# EasyEDA Pro project Athena.eprj, schematic Schematic, sheet 1 of 4

## Sheets
1 Processors: Board Name: Board; Create Date: 2025-08-10; Page Name: Processors; Project Name: Athena; Schematic Name: Schematic; Update Date: 2025-09-05; Company: EasyEDA.com; Page Size: A4; Version: V1.0
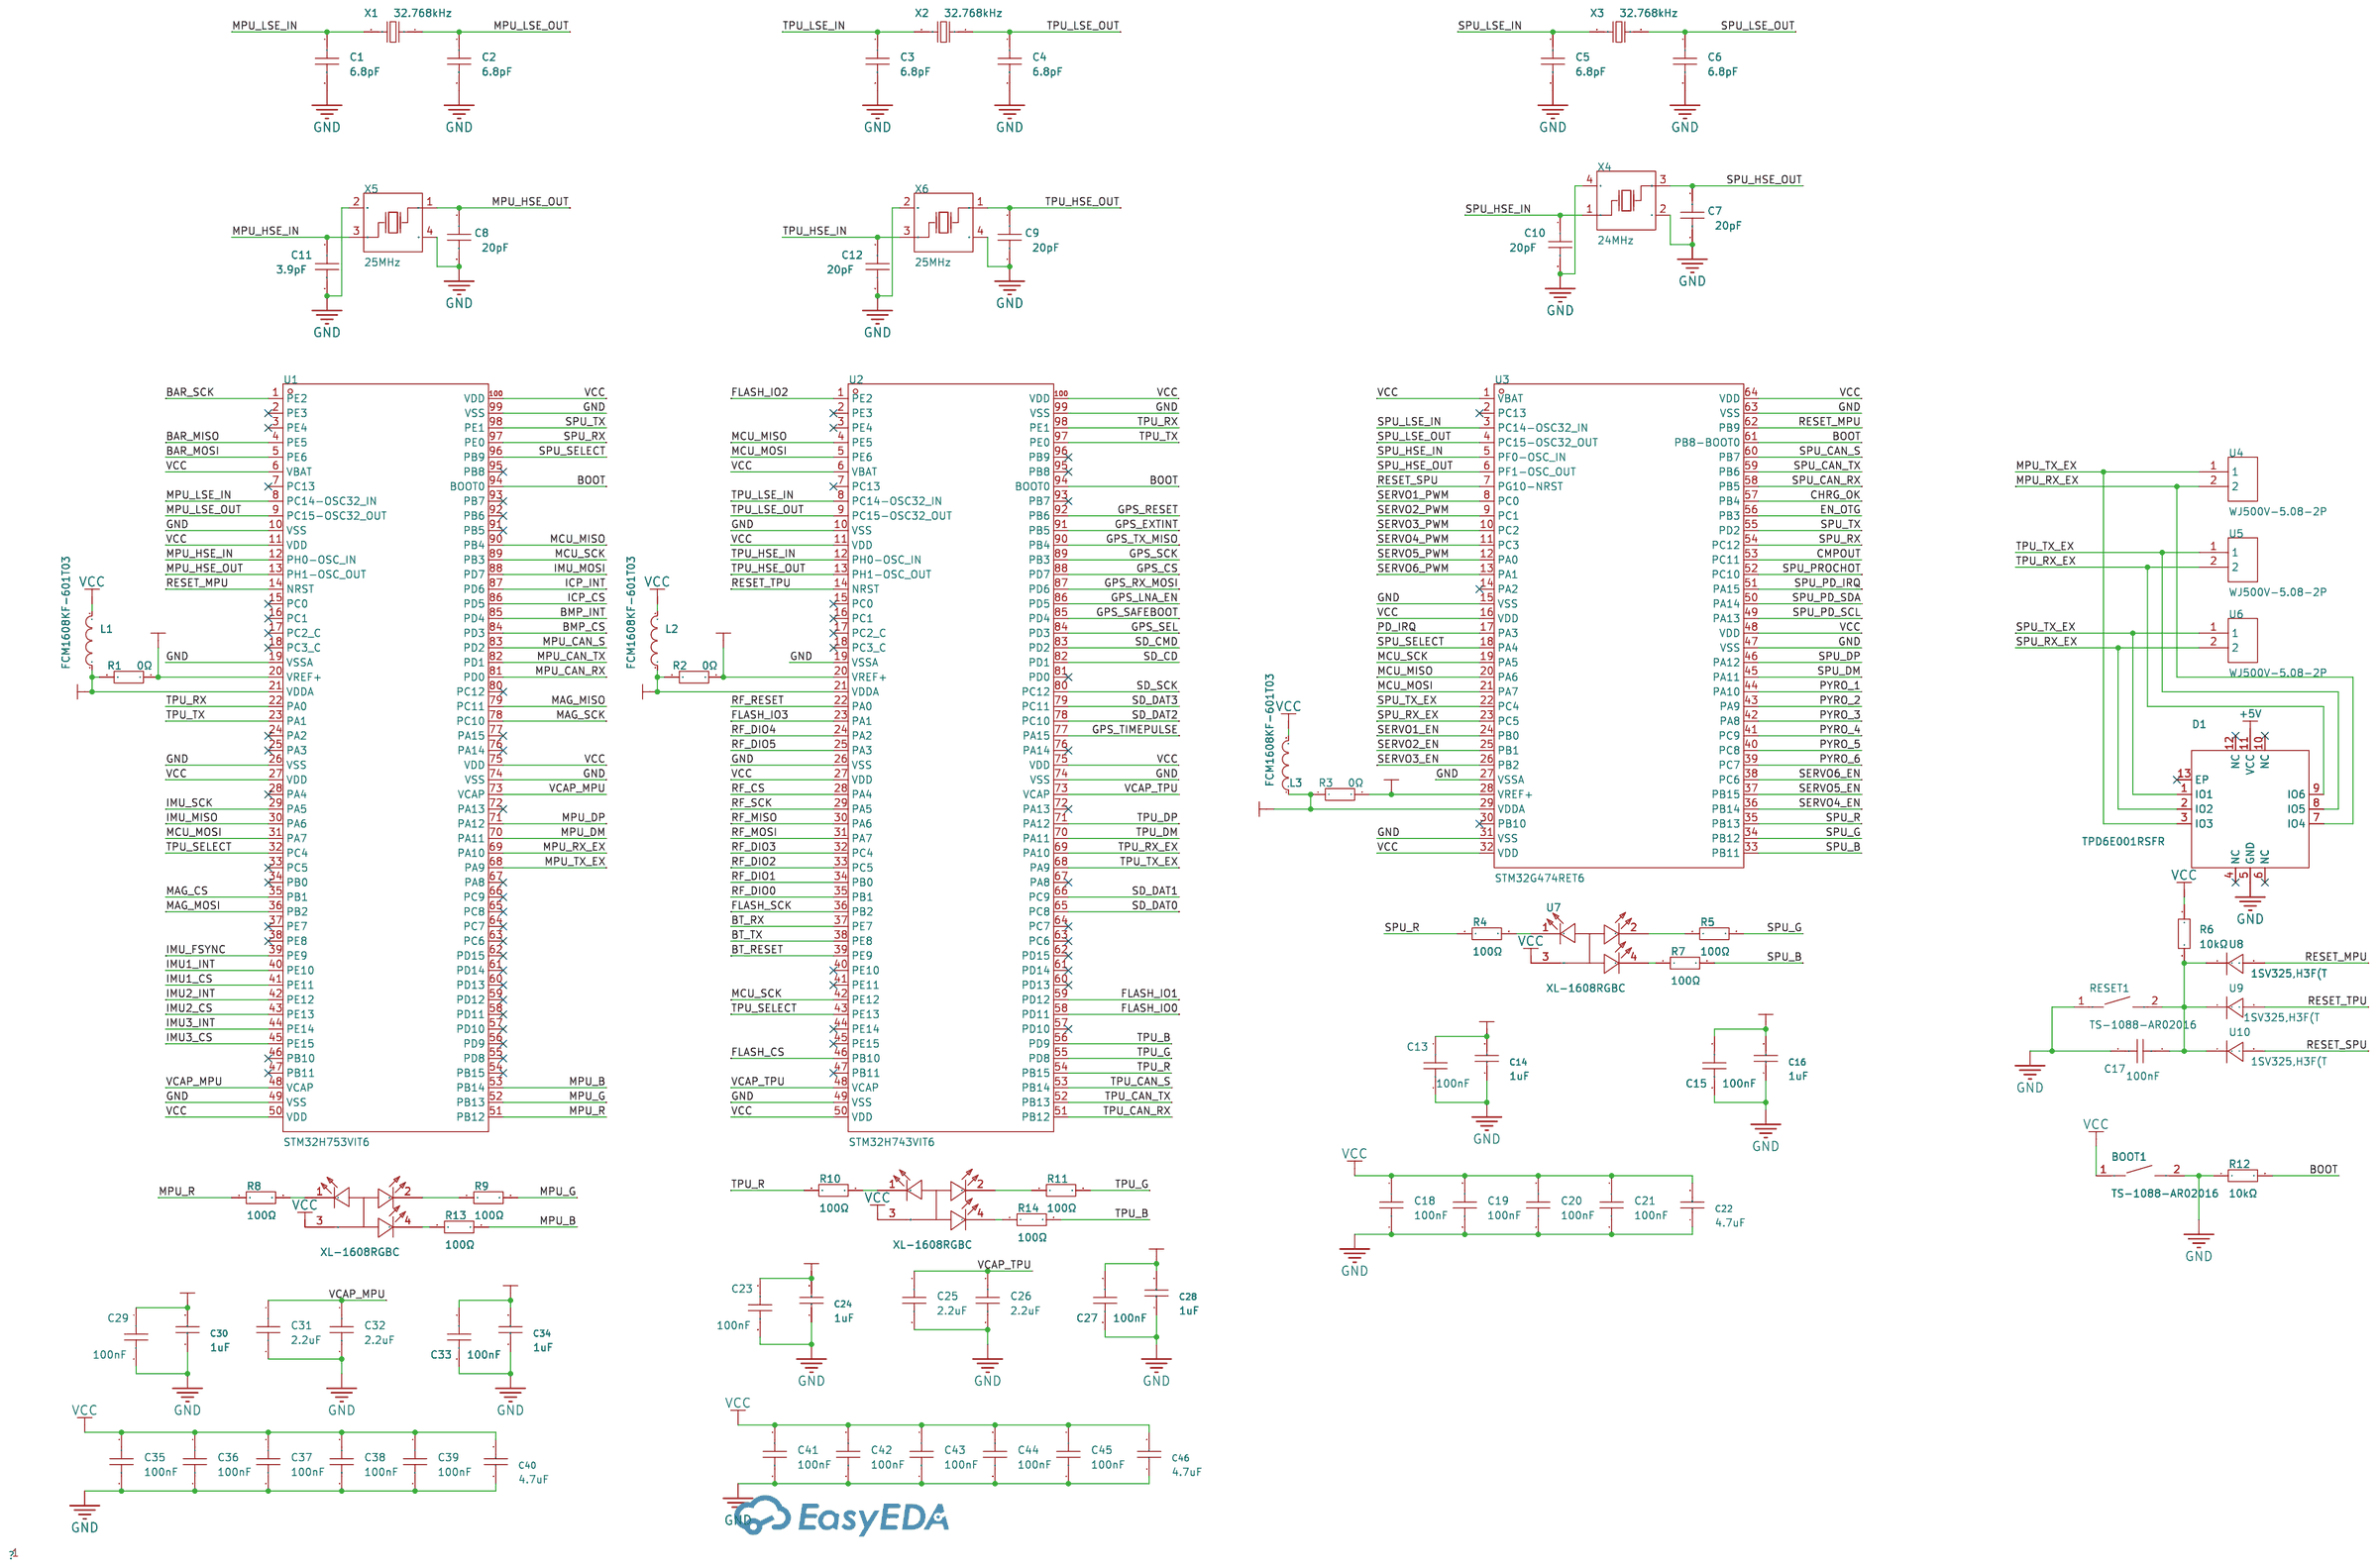
[diagram p0: Processors]

## Parts
BOOT1  6.8pF  [SW-SMD_L3.9-W3.0-P4.45]
C1  6.8pF  [C0402]
C2  6.8pF  [C0402]
C3  6.8pF  [C0402]
C4  6.8pF  [C0402]
C5  6.8pF  [C0402]
C6  6.8pF  [C0402]
C7  20pF  [C0402]
C8  20pF  [C0402]
C9  20pF  [C0402]
C10  20pF  [C0402]
C11  3.9pF  [C0402]
C12  20pF  [C0402]
C13  100nF  [C0402]
C14  1uF  [C0402]
C15  100nF  [C0402]
C16  1uF  [C0402]
C17  100nF  [C0402]
C18  100nF  [C0402]
C19  100nF  [C0402]
C20  100nF  [C0402]
C21  100nF  [C0402]
C22  4.7uF  [C0402]
C23  100nF  [C0402]
C24  1uF  [C0402]
C25  2.2uF  [C0402]
C26  2.2uF  [C0402]
C27  100nF  [C0402]
C28  1uF  [C0402]
C29  100nF  [C0402]
C30  1uF  [C0402]
C31  2.2uF  [C0402]
C32  2.2uF  [C0402]
C33  100nF  [C0402]
C34  1uF  [C0402]
C35  100nF  [C0402]
C36  100nF  [C0402]
C37  100nF  [C0402]
C38  100nF  [C0402]
C39  100nF  [C0402]
C40  4.7uF  [C0402]
C41  100nF  [C0402]
C42  100nF  [C0402]
C43  100nF  [C0402]
C44  100nF  [C0402]
C45  100nF  [C0402]
C46  4.7uF  [C0402]
D1  TPD6E001RSFR  [QFN-12_L4.0-W4.0-P0.80-BL-EP1.7]
L1  FCM1608KF-601T03  [L0603]
L2  FCM1608KF-601T03  [L0603]
L3  FCM1608KF-601T03  [L0603]
R1  0Ω  [R0402]
R2  0Ω  [R0402]
R3  0Ω  [R0402]
R4  100Ω  [R0402]
R5  100Ω  [R0402]
R6  10kΩ  [R0603]
R7  100Ω  [R0402]
R8  100Ω  [R0402]
R9  100Ω  [R0402]
R10  100Ω  [R0402]
R11  100Ω  [R0402]
R12  10kΩ  [R0402]
R13  100Ω  [R0402]
R14  100Ω  [R0402]
RESET1  TS-1088-AR02016  [SW-SMD_L3.9-W3.0-P4.45]
U1  STM32H753VIT6  [LQFP-100_L14.0-W14.0-P0.50-LS16.0-BL]
U2  STM32H743VIT6  [LQFP-100_L14.0-W14.0-P0.50-LS16.0-BL]
U3  STM32G474RET6  [LQFP-64_L10.0-W10.0-P0.50-LS12.0-BL]
U4  WJ500V-5.08-2P  [CONN-TH_2P-P5.00_WJ500V-5.08-2P]
U5  WJ500V-5.08-2P  [CONN-TH_2P-P5.00_WJ500V-5.08-2P]
U6  WJ500V-5.08-2P  [CONN-TH_2P-P5.00_WJ500V-5.08-2P]
U7  XL-1608RGBC  [LED-SMD_4P-L1.6-W0.8-BL]
U8  1SV325,H3F(T  [SOD-523_L1.2-W0.8-LS1.6-RD]
U9  1SV325,H3F(T  [SOD-523_L1.2-W0.8-LS1.6-RD]
U10  1SV325,H3F(T  [SOD-523_L1.2-W0.8-LS1.6-RD]
U11  XL-1608RGBC  [LED-SMD_4P-L1.6-W0.8-BL]
U12  XL-1608RGBC  [LED-SMD_4P-L1.6-W0.8-BL]
X1  32.768kHz  [FC-135R_L3.2-W1.5]
X2  32.768kHz  [FC-135R_L3.2-W1.5]
X3  32.768kHz  [FC-135R_L3.2-W1.5]
X4  24MHz  [CRYSTAL-SMD_4P-L3.2-W2.5-BL]
X5  25MHz  [CRYSTAL-SMD_4P-L3.2-W2.5-BL]
X6  25MHz  [CRYSTAL-SMD_4P-L3.2-W2.5-BL]

## Library data of the parts
BOOT1 = TS-1088-AR02016: LCSC Part Name: 4*3*2mm 立贴 轻触开关; Supplier Part: C720477; Manufacturer: XUNPU(讯普); Supplier Footprint: SMD; JLCPCB Part Class: Basic Part; Datasheet: https://atta.szlcsc.com/upload/public/pdf/source/20200810/C720475_60D09DD6C54279ADDB2DC25100F1CC11.pdf; Supplier: LCSC; Circuit: SPST; Actuator Style: Round Button; Operating Force: 160gf; Mounting Style: Brick nogging; Switch Length: 4mm; Switch Width: 3mm; Switch Height: 2mm; Strike Gundam: 不带; Contact Current: 50mA; Voltage Rating (DC): 12V; Insulation Resistance: 100MΩ; Actuator/Cap Color: Black; Pin Style: SMDSplicing; Mechanical Life: 10万次; Operating Temperature: -30℃~+80℃; Voltage Rating: 50V
C1-C6 = CC0402CRNPO9BN6R8: LCSC Part Name: ±0.25pF 6.8pF 50V; Supplier Part: C189470; Manufacturer: YAGEO(国巨); Supplier Footprint: 0402; JLCPCB Part Class: Extended Part; Datasheet: https://item.szlcsc.com/datasheet/CC0402CRNPO9BN6R8/200930.html; Supplier: LCSC; Voltage Rating: 50V; Temperature Coefficient: NP0; Standardization Check: false
C7-C10 C12 = CC0402JRNPO9BN200: LCSC Part Name: 20pF ±5% 50V; Supplier Part: C107000; Manufacturer: YAGEO(国巨); Supplier Footprint: 0402; JLCPCB Part Class: Extended Part; Datasheet: https://atta.szlcsc.com/upload/public/pdf/source/20170914/C128857_1505359892143968080.pdf; Supplier: LCSC; Tolerance: ±5%; Standardization Check: true
C11 = 0402CG3R9C500NT: LCSC Part Name: ±0.25pF 3.9pF 50V; Supplier Part: C1566; Manufacturer: FH(风华); Supplier Footprint: 0402; JLCPCB Part Class: Extended Part; Datasheet: https://item.szlcsc.com/datasheet/0402CG3R9C500NT/1918.html; Supplier: LCSC; Voltage Rating: 50V; Temperature Coefficient: C0G; Standardization Check: true
C13 C15 C17-C21 C23 C27 C29 C33 C35-C39 C41-C45 = GRM155R71H104KE14D: LCSC Part Name: 100nF ±10% 50V; Supplier Part: C77020; Manufacturer: muRata(村田); Supplier Footprint: 0402; JLCPCB Part Class: Extended Part; Datasheet: https://atta.szlcsc.com/upload/public/pdf/source/20180326/C77020_39BD49C951FF1AF0DB1F1FAC5AC1E401.pdf; Supplier: LCSC; Tolerance: ±10%; Standardization Check: false
C14 C16 C24 C28 C30 C34 = CL05A105KP5NNNC: LCSC Part Name: 1uF ±10% 10V; Supplier Part: C14445; Manufacturer: SAMSUNG(三星); Supplier Footprint: 0402; JLCPCB Part Class: Extended Part; Datasheet: https://item.szlcsc.com/datasheet/CL05A105KP5NNNC/15107.html; Supplier: LCSC; Tolerance: ±10%; Voltage Rating: 10V; Temperature Coefficient: X5R
C22 C40 C46 = CL05A475MP5NRNC: LCSC Part Name: 4.7uF ±20% 10V; Supplier Part: C23733; Manufacturer: SAMSUNG(三星); Supplier Footprint: 0402; JLCPCB Part Class: Basic Part; Datasheet: https://item.szlcsc.com/datasheet/CL05A475MP5NRNC/24469.html; Supplier: LCSC; Tolerance: ±20%; Voltage Rating: 10V; Temperature Coefficient: X5R
C25 C26 C31 C32 = CL05A225KO5NQNC: LCSC Part Name: 2.2uF ±10% 16V; Supplier Part: C170151; Manufacturer: SAMSUNG(三星); Supplier Footprint: 0402; JLCPCB Part Class: Extended Part; Datasheet: https://item.szlcsc.com/datasheet/CL05A225KO5NQNC/181536.html; Supplier: LCSC; Tolerance: ±10%; Voltage Rating: 16V; Temperature Coefficient: X5R; Standardization Check: false
D1 = TPD6E001RSFR: Supplier Part: C1975428; Manufacturer: TI(德州仪器); Supplier Footprint: QFN-12-EP(4x4); JLCPCB Part Class: Extended Part; Datasheet: https://www.ti.com/cn/lit/gpn/tpd6e001; Supplier: LCSC; Reverse Stand-Off Voltage (Vrwm): 5V; Breakdown Voltage: 11V; Operating Temperature: -40℃~+85℃@(Ta); Type: ESD
L1-L3 = FCM1608KF-601T03: Impedance @ Frequency:600Ω@100MHz Tolerance:±25% Tolerance:±25% DC Resistance:500mΩ Current Rating:350mA Circuits:1; LCSC Part Name: 单路 0603磁珠 阻抗600Ω@100MHz; Supplier Part: C141723; Manufacturer: TAI-TECH(台庆); Supplier Footprint: 0603; JLCPCB Part Class: Extended Part; Datasheet: https://atta.szlcsc.com/upload/public/pdf/source/20200917/C141723_92A33AED1D8E5BDD57999587466F99AE.pdf; Supplier: LCSC; Impedance @ Frequency: 600Ω@100MHz; Tolerance: ±25%; DC Resistance: 500mΩ; Current Rating: 350mA; Circuits: 1
R1-R3 = 0402WGF0000TCE: LCSC Part Name: 0Ω ±1% 62.5mW 厚膜电阻; Supplier Part: C17168; Manufacturer: UNI-ROYAL(厚声); Supplier Footprint: 0402; JLCPCB Part Class: Basic Part; Datasheet: https://item.szlcsc.com/datasheet/0402WGF0000TCE/17853.html; Supplier: LCSC; Type: Thick Film Resistor; Tolerance: ±1%; Power(Watts): 62.5mW; Voltage-Supply(Max): 50V; Temperature Coefficient: ±800ppm/℃; Operating Temperature: -55℃~+155℃; Standardization Check: false
R4 R5 R7-R11 R13 R14 = 0402WGF1000TCE: LCSC Part Name: 100Ω ±1% 62.5mW 厚膜电阻; Supplier Part: C25076; Manufacturer: UNI-ROYAL(厚声); Supplier Footprint: 0402; JLCPCB Part Class: Basic Part; Datasheet: https://atta.szlcsc.com/upload/public/pdf/source/20200306/C422600_1E6D84923E4A46A82E41ADD87F860B5C.pdf; Supplier: LCSC; Type: Thick Film Resistors; Tolerance: ±1%; Temperature Coefficient: ±200ppm/℃; Operating Temperature Range: -55℃~+155℃; Standardization Check: false
R6 = 0603WAF1002T5E: Type:Thick Film Resistor Resistance:10kΩ Tolerance:±1% Tolerance:±1% Power(Watts):100mW Voltage-Supply(Max):75V Temperature Coefficient:±100ppm/℃ Temperature Coefficient:±100ppm/℃ Operating Temperature:-55℃~+155℃ Operating Temperature:-55℃~+155℃; LCSC Part Name: 厚膜电阻 10kΩ ±1% 100mW; Supplier Part: C25804; Manufacturer: UNI-ROYAL(厚声); Supplier Footprint: 0603; JLCPCB Part Class: Basic Part; Datasheet: https://item.szlcsc.com/datasheet/0603WAF1002T5E/26547.html; Supplier: LCSC; Type: Thick Film Resistor; Tolerance: ±1%; Power(Watts): 100mW; Voltage-Supply(Max): 75V; Temperature Coefficient: ±100ppm/℃; Operating Temperature: -55℃~+155℃
R12 = 0402WGF1002TCE: LCSC Part Name: 10kΩ ±1% 62.5mW 厚膜电阻; Supplier Part: C25744; Manufacturer: UNI-ROYAL(厚声); Supplier Footprint: 0402; JLCPCB Part Class: Basic Part; Datasheet: https://item.szlcsc.com/datasheet/0402WGF1002TCE/26487.html; Supplier: LCSC; Type: Thick Film Resistor; Tolerance: ±1%; Power(Watts): 62.5mW; Voltage-Supply(Max): 50V; Temperature Coefficient: ±100ppm/℃; Operating Temperature: -55℃~+155℃; Standardization Check: false
RESET1 = TS-1088-AR02016: LCSC Part Name: 4*3*2mm 立贴 轻触开关; Supplier Part: C720477; Manufacturer: XUNPU(讯普); Supplier Footprint: SMD; JLCPCB Part Class: Basic Part; Datasheet: https://atta.szlcsc.com/upload/public/pdf/source/20200810/C720475_60D09DD6C54279ADDB2DC25100F1CC11.pdf; Supplier: LCSC; Circuit: SPST; Actuator Style: Round Button; Operating Force: 160gf; Mounting Style: Brick nogging; Switch Length: 4mm; Switch Width: 3mm; Switch Height: 2mm; Strike Gundam: 不带; Contact Current: 50mA; Voltage Rating (DC): 12V; Insulation Resistance: 100MΩ; Actuator/Cap Color: Black; Pin Style: SMDSplicing; Mechanical Life: 10万次; Operating Temperature: -30℃~+80℃
U1 = STM32H753VIT6: LCSC Part Name: 带DSP和DP-FPU的高性能ARM Cortex-M7 MCU，具有2 MB Flash、1 MB RAM、480 MHz CPU、ART加速器、一级缓存、外部存储器接口、包括加密加速器在内的大量外设以及安全服务支持; Supplier Part: C730206; Manufacturer: ST(意法半导体); Supplier Footprint: LQFP-100(14x14); JLCPCB Part Class: Extended Part; Datasheet: https://item.szlcsc.com/datasheet/STM32H753VIT6/778161.html; Supplier: LCSC
U2 = STM32H743VIT6_C114409: CPU Core:ARM Cortex-M Series CPU Maximum Speed:480MHz Program Storage Size:2MB Number of I/O:82 ADC (Bit):16bit DAC (Bit):12bit Voltage - Supply:1.71V~3.6V Voltage - Supply:1.71V~3.6V Applications:-; LCSC Part Name: 带DSP和DP-FPU的高性能ARM Cortex-M7 MCU，具有2 MB Flash、1 MB RAM、480 MHz CPU、ART加速器、一级缓存、外部存储器接口和大量外设; Supplier Part: C114409; Manufacturer: ST(意法半导体); Supplier Footprint: LQFP-100(14x14); JLCPCB Part Class: Extended Part; Datasheet: https://atta.szlcsc.com/upload/public/pdf/source/20200508/C529058_DA70143F266D6D825C3A912656F12A87.pdf; Supplier: LCSC; CPU Core: ARM Cortex-M Series; CPU Maximum Speed: 480MHz; Program Storage Size: 2MB; Number of I/O: 82; ADC (Bit): 16bit; DAC (Bit): 12bit; Voltage - Supply: 1.71V~3.6V
U3 = STM32G474RET6: CPU Core:ARM-M4 CPU Maximum Speed:170MHz Program Storage Size:512KB Program Memory Type:FLASH Number of I/O:52 ADC (Bit):12bit DAC (Bit):12bit Voltage - Supply:1.71V~3.6V Voltage - Supply:1.71V~3.6V Applications:-; LCSC Part Name: 带DSP和FPU的170MHz主流ARM Cortex-M4 MCU，具有512 KB Flash存储器、数学加速器、高分辨率定时器和高模拟电平集成; Supplier Part: C521608; Manufacturer: ST(意法半导体); Supplier Footprint: LQFP-64(10x10); JLCPCB Part Class: Extended Part; Datasheet: https://item.szlcsc.com/datasheet/STM32G474RET6/538858.html; Supplier: LCSC; CPU Core: ARM-M4; CPU Maximum Speed: 170MHz; Program Storage Size: 512KB; Program Memory Type: FLASH; Number of I/O: 52; ADC (Bit): 12bit; DAC (Bit): 12bit; Voltage - Supply: 1.71V~3.6V
U4-U6 = WJ500V-5.08-2P: LCSC Part Name: 1x2P 5.08mm 直插 排数:1 每排P数:2; Supplier Part: C8465; Manufacturer: KANGNEX(康奈克斯电气); Supplier Footprint: 插件,P=5.08mm; JLCPCB Part Class: Extended Part; Datasheet: https://atta.szlcsc.com/upload/public/pdf/source/20191225/C8465_02D34CE5B5B4A53DF5891601D97FA9F4.pdf; Supplier: LCSC; Structure: 1x2P; Pitch: 5.08mm; Color: Green; Mounting Style: Direct Insert; Current Rating (Max): 18A; Voltage Rating (Max): 250V; Number of Pins: 2P; Number of Rows: 1; Wire Gauge - AWG: 14~30; Wire Gauge - mm2: 2.5; Number of PINs Per Row: 2; Operating Temperature Range: -40℃~+105℃; Screw Specification: M2.5
U7 U11 U12 = XL-1608RGBC: Supplier Part: C5349936; Manufacturer: XINGLIGHT(成兴光); Supplier Footprint: 0603; JLCPCB Part Class: Extended Part; Datasheet: https://atta.szlcsc.com/upload/public/pdf/source/20240218/D6E53B1911387F9E4C84048A3296A5A3.pdf; Supplier: LCSC; Viewing Angle: 120°; Lens Color: Colorless transparent lens; Installation Method: Positive Stick; Operating Temperature: -30℃~+85℃
U8-U10 = 1SV325,H3F(T: Supplier Part: C4153758; Manufacturer: TOSHIBA(东芝); Supplier Footprint: SOD-523; JLCPCB Part Class: Extended Part; Datasheet: https://atta.szlcsc.com/upload/public/pdf/source/20210326/C2762670_F0C124BCF192D7BD99D0C869063EDCD5.pdf; Supplier: LCSC
X1-X3 = Q13FC13500004_C32346: LCSC Part Name: 32.768kHz ±20ppm 12.5pF; Supplier Part: C32346; Manufacturer: EPSON(爱普生); Manufacturer Part: Q13FC13500004; Supplier Footprint: SMD3215-2P; JLCPCB Part Class: Basic Part; Datasheet: https://atta.szlcsc.com/upload/public/pdf/source/20240418/0E0FF5F0356BA3753F616001439D1416.pdf; Supplier: LCSC; Crystal Type: Surface Mount Crystal; Normal temperature Frequency Tolerance: ±20ppm; Equivalent Series Resistance (ESR): 70kΩ
X4 = X322524MOB4SI: LCSC Part Name: YSX321SL 24MHZ 4P 3225 12PF ±10PPM -40~85℃ (±20PPM); Supplier Part: C70590; Manufacturer: YXC(扬兴晶振); Supplier Footprint: SMD3225-4P; JLCPCB Part Class: Extended Part; Datasheet: https://atta.szlcsc.com/upload/public/pdf/source/20240329/19D5F850207469550BEB00D7DFEDBC7A.pdf; Supplier: LCSC; Type: Surface Mount Crystal; Normal temperature Frequency Tolerance: ±10ppm; Load Capacitance: 12pF; Frequency Stability: ±20ppm; Operating Temperature: -40℃~+85℃
X5 X6 = X322525MOB4SI: LCSC Part Name: YSX321SL 25MHZ 4P 3225 12PF ±10PPM -40~85℃ (±20PPM); Supplier Part: C9006; Manufacturer: YXC(扬兴晶振); Supplier Footprint: SMD3225-4P; JLCPCB Part Class: Basic Part; Datasheet: https://atta.szlcsc.com/upload/public/pdf/source/20240329/19D5F850207469550BEB00D7DFEDBC7A.pdf; Supplier: LCSC; Type: Surface Mount Crystal; Normal temperature Frequency Tolerance: ±10ppm; Load Capacitance: 12pF; Frequency Stability: ±20ppm; Operating Temperature: -40℃~+85℃

## Nets
+5V: D1.11(VCC) ; also on sheet 2 3
GND: BOOT1.2 C1.2 C2.2 C3.2 C4.2 C5.2 C6.2 C7.2 C8.2 C9.2 C10.2 C11.2 C12.2 C13.2 C14.1 C15.2 C16.1 C17.2 C18.2 C19.2 C20.2 C21.2 C22.1 C23.2 C24.1 C25.2 C26.2 C27.2 C28.1 C29.2 C30.1 C31.2 C32.2 C33.2 C34.1 C35.2 C36.2 C37.2 C38.2 C39.2 C40.1 C41.2 C42.2 C43.2 C44.2 C45.2 C46.1 D1.5(GND) R12.1 RESET1.1 U1.10(VSS) U1.19(VSSA) U1.26(VSS) U1.49(VSS) U1.74(VSS) U1.99(VSS) U2.10(VSS) U2.19(VSSA) U2.26(VSS) U2.49(VSS) U2.74(VSS) U2.99(VSS) U3.15(VSS) U3.27(VSSA) U3.31(VSS) U3.47(VSS) U3.63(VSS) X4.2(GND) X4.4(GND) X5.2(GND) X5.4(GND) X6.2(GND) X6.4(GND) ; also on sheet 2 3 4
VCC: BOOT1.1 C18.1 C19.1 C20.1 C21.1 C22.2 C35.1 C36.1 C37.1 C38.1 C39.1 C40.2 C41.1 C42.1 C43.1 C44.1 C45.1 C46.2 L1.2 L2.2 L3.2 R6.2 U1.6(VBAT) U1.11(VDD) U1.27(VDD) U1.50(VDD) U1.75(VDD) U1.100(VDD) U2.6(VBAT) U2.11(VDD) U2.27(VDD) U2.50(VDD) U2.75(VDD) U2.100(VDD) U3.1(VBAT) U3.16(VDD) U3.32(VDD) U3.48(VDD) U3.64(VDD) U7.3(com) U11.3(com) U12.3(com) ; also on sheet 2 3 4
VDDA_MPU: C29.1 C30.2 L1.1 R1.1 U1.21(VDDA)
VDDA_SPU: C13.1 C14.2 L3.1 R3.1 U3.29(VDDA)
VDDA_TPU: C23.1 C24.2 L2.1 R2.1 U2.21(VDDA)
BAR_MISO: U1.4(PE5) ; also on sheet 4
BAR_MOSI: U1.5(PE6) ; also on sheet 4
BAR_SCK: U1.1(PE2) ; also on sheet 4
BMP_CS: U1.84(PD3) ; also on sheet 4
BMP_INT: U1.85(PD4) ; also on sheet 4
BOOT: R12.2 U1.94(BOOT0) U2.94(BOOT0) U3.61(PB8-BOOT0)
BT_RESET: U2.39(PE9) ; also on sheet 3
BT_RX: U2.37(PE7) ; also on sheet 3
BT_TX: U2.38(PE8) ; also on sheet 3
CHRG_OK: U3.57(PB4) ; also on sheet 2
CMPOUT: U3.53(PC11) ; also on sheet 2
EN_OTG: U3.56(PB3) ; also on sheet 2
FLASH_CS: U2.46(PB10) ; also on sheet 3
FLASH_IO0: U2.58(PD11) ; also on sheet 3
FLASH_IO1: U2.59(PD12) ; also on sheet 3
FLASH_IO2: U2.1(PE2) ; also on sheet 3
FLASH_IO3: U2.23(PA1) ; also on sheet 3
FLASH_SCK: U2.36(PB2) ; also on sheet 3
GPS_CS: U2.88(PD7) ; also on sheet 3
GPS_EXTINT: U2.91(PB5) ; also on sheet 3
GPS_LNA_EN: U2.86(PD5) ; also on sheet 3
GPS_RESET: U2.92(PB6) ; also on sheet 3
GPS_RX_MOSI: U2.87(PD6) ; also on sheet 3
GPS_SAFEBOOT: U2.85(PD4) ; also on sheet 3
GPS_SCK: U2.89(PB3) ; also on sheet 3
GPS_SEL: U2.84(PD3) ; also on sheet 3
GPS_TIMEPULSE: U2.77(PA15) ; also on sheet 3
GPS_TX_MISO: U2.90(PB4) ; also on sheet 3
ICP_CS: U1.86(PD5) ; also on sheet 4
ICP_INT: U1.87(PD6) ; also on sheet 4
IMU1_CS: U1.41(PE11) ; also on sheet 4
IMU1_INT: U1.40(PE10) ; also on sheet 4
IMU2_CS: U1.43(PE13) ; also on sheet 4
IMU2_INT: U1.42(PE12) ; also on sheet 4
IMU3_CS: U1.45(PE15) ; also on sheet 4
IMU3_INT: U1.44(PE14) ; also on sheet 4
IMU_FSYNC: U1.39(PE9) ; also on sheet 4
IMU_MISO: U1.30(PA6) ; also on sheet 4
IMU_MOSI: U1.88(PD7) ; also on sheet 4
IMU_SCK: U1.29(PA5) ; also on sheet 4
MAG_CS: U1.35(PB1) ; also on sheet 4
MAG_MISO: U1.79(PC11) ; also on sheet 4
MAG_MOSI: U1.36(PB2) ; also on sheet 4
MAG_SCK: U1.78(PC10) ; also on sheet 4
MCU_MISO: U1.90(PB4) U2.4(PE5) U3.20(PA6)
MCU_MOSI: U1.31(PA7) U2.5(PE6) U3.21(PA7)
MCU_SCK: U1.89(PB3) U2.42(PE12) U3.19(PA5)
MPU_B: R13.2 U1.53(PB14)
MPU_CAN_RX: U1.81(PD0) ; also on sheet 3
MPU_CAN_S: U1.83(PD2) ; also on sheet 3
MPU_CAN_TX: U1.82(PD1) ; also on sheet 3
MPU_DM: U1.70(PA11) ; also on sheet 3
MPU_DP: U1.71(PA12) ; also on sheet 3
MPU_G: R9.2 U1.52(PB13)
MPU_HSE_IN: C11.1 U1.12(PH0-OSC_IN) X5.3(OSC2)
MPU_HSE_OUT: C8.1 U1.13(PH1-OSC_OUT) X5.1(OSC1)
MPU_LSE_IN: C1.1 U1.8(PC14-OSC32_IN) X1.2
MPU_LSE_OUT: C2.1 U1.9(PC15-OSC32_OUT) X1.1
MPU_R: R8.1 U1.51(PB12)
MPU_RX_EX: D1.7(IO4) U1.69(PA10) U4.2
MPU_TX_EX: D1.3(IO3) U1.68(PA9) U4.1
PD_IRQ: U3.17(PA3) ; also on sheet 2
PYRO_1: U3.44(PA10) ; also on sheet 3
PYRO_2: U3.43(PA9) ; also on sheet 3
PYRO_3: U3.42(PA8) ; also on sheet 3
PYRO_4: U3.41(PC9) ; also on sheet 3
PYRO_5: U3.40(PC8) ; also on sheet 3
PYRO_6: U3.39(PC7) ; also on sheet 3
RESET_MPU: U1.14(NRST) U3.62(PB9) U8.2(A)
RESET_SPU: U3.7(PG10-NRST) U10.2(A)
RESET_TPU: U2.14(NRST) U9.2(A)
RF_CS: U2.28(PA4) ; also on sheet 3
RF_DIO0: U2.35(PB1) ; also on sheet 3
RF_DIO1: U2.34(PB0) ; also on sheet 3
RF_DIO2: U2.33(PC5) ; also on sheet 3
RF_DIO3: U2.32(PC4) ; also on sheet 3
RF_DIO4: U2.24(PA2) ; also on sheet 3
RF_DIO5: U2.25(PA3) ; also on sheet 3
RF_MISO: U2.30(PA6) ; also on sheet 3
RF_MOSI: U2.31(PA7) ; also on sheet 3
RF_RESET: U2.22(PA0) ; also on sheet 3
RF_SCK: U2.29(PA5) ; also on sheet 3
SD_CD: U2.82(PD1) ; also on sheet 3
SD_CMD: U2.83(PD2) ; also on sheet 3
SD_DAT0: U2.65(PC8) ; also on sheet 3
SD_DAT1: U2.66(PC9) ; also on sheet 3
SD_DAT2: U2.78(PC10) ; also on sheet 3
SD_DAT3: U2.79(PC11) ; also on sheet 3
SD_SCK: U2.80(PC12) ; also on sheet 3
SERVO1_EN: U3.24(PB0) ; also on sheet 3
SERVO1_PWM: U3.8(PC0) ; also on sheet 3
SERVO2_EN: U3.25(PB1) ; also on sheet 3
SERVO2_PWM: U3.9(PC1) ; also on sheet 3
SERVO3_EN: U3.26(PB2) ; also on sheet 3
SERVO3_PWM: U3.10(PC2) ; also on sheet 3
SERVO4_EN: U3.36(PB14) ; also on sheet 3
SERVO4_PWM: U3.11(PC3) ; also on sheet 3
SERVO5_EN: U3.37(PB15) ; also on sheet 3
SERVO5_PWM: U3.12(PA0) ; also on sheet 3
SERVO6_EN: U3.38(PC6) ; also on sheet 3
SERVO6_PWM: U3.13(PA1) ; also on sheet 3
SPU_B: R7.2 U3.33(PB11)
SPU_CAN_RX: U3.58(PB5) ; also on sheet 3
SPU_CAN_S: U3.60(PB7) ; also on sheet 3
SPU_CAN_TX: U3.59(PB6) ; also on sheet 3
SPU_DM: U3.45(PA11) ; also on sheet 3
SPU_DP: U3.46(PA12) ; also on sheet 3
SPU_G: R5.2 U3.34(PB12)
SPU_HSE_IN: C10.1 U3.5(PF0-OSC_IN) X4.1(OSC1)
SPU_HSE_OUT: C7.1 U3.6(PF1-OSC_OUT) X4.3(OSC2)
SPU_LSE_IN: C5.1 U3.3(PC14-OSC32_IN) X3.2
SPU_LSE_OUT: C6.1 U3.4(PC15-OSC32_OUT) X3.1
SPU_PD_IRQ: U3.51(PA15) ; also on sheet 2
SPU_PD_SCL: U3.49(PA13) ; also on sheet 2
SPU_PD_SDA: U3.50(PA14) ; also on sheet 2
SPU_PROCHOT: U3.52(PC10) ; also on sheet 2
SPU_R: R4.1 U3.35(PB13)
SPU_RX: U1.97(PE0) U3.54(PC12)
SPU_RX_EX: D1.2(IO2) U3.23(PC5) U6.2
SPU_SELECT: U1.96(PB9) U3.18(PA4)
SPU_TX: U1.98(PE1) U3.55(PD2)
SPU_TX_EX: D1.1(IO1) U3.22(PC4) U6.1
TPU_B: R14.2 U2.56(PD9)
TPU_CAN_RX: U2.51(PB12) ; also on sheet 3
TPU_CAN_S: U2.53(PB14) ; also on sheet 3
TPU_CAN_TX: U2.52(PB13) ; also on sheet 3
TPU_DM: U2.70(PA11) ; also on sheet 3
TPU_DP: U2.71(PA12) ; also on sheet 3
TPU_G: R11.2 U2.55(PD8)
TPU_HSE_IN: C12.1 U2.12(PH0-OSC_IN) X6.3(OSC2)
TPU_HSE_OUT: C9.1 U2.13(PH1-OSC_OUT) X6.1(OSC1)
TPU_LSE_IN: C3.1 U2.8(PC14-OSC32_IN) X2.2
TPU_LSE_OUT: C4.1 U2.9(PC15-OSC32_OUT) X2.1
TPU_R: R10.1 U2.54(PB15)
TPU_RX: U1.22(PA0) U2.98(PE1)
TPU_RX_EX: D1.9(IO6) U2.69(PA10) U5.2
TPU_SELECT: U1.32(PC4) U2.43(PE13)
TPU_TX: U1.23(PA1) U2.97(PE0)
TPU_TX_EX: D1.8(IO5) U2.68(PA9) U5.1
VCAP_MPU: C31.1 C32.1 U1.48(VCAP) U1.73(VCAP)
VCAP_TPU: C25.1 C26.1 U2.48(VCAP) U2.73(VCAP)
VREF+_MPU: C33.1 C34.2 R1.2 U1.20(VREF+)
VREF+_SPU: C15.1 C16.2 R3.2 U3.28(VREF+)
VREF+_TPU: C27.1 C28.2 R2.2 U2.20(VREF+)
$1N13958: R8.2 U11.1
$1N14012: R9.1 U11.2
$1N14042: R13.1 U11.4
$1N15981: R10.2 U12.1
$1N15984: R11.1 U12.2
$1N15987: R14.1 U12.4
$1N16115: R4.2 U7.1
$1N16118: R5.1 U7.2
$1N16121: R7.1 U7.4
$1N31524: C17.1 R6.1 RESET1.2 U8.1(K) U9.1(K) U10.1(K)

Not connected (* = marked no-connect by the designer): D1 4(NC)* 6(NC)* 10(NC)* 12(NC)* 13(EP)*; U1 2(PE3)* 3(PE4)* 7(PC13)* 15(PC0)* 16(PC1)* 17(PC2_C)* 18(PC3_C)* 24(PA2)* 25(PA3)* 28(PA4)* 33(PC5)* 34(PB0)* 37(PE7)* 38(PE8)* 46(PB10)* 47(PB11)* 54(PB15)* 55(PD8)* 56(PD9)* 57(PD10)* 58(PD11)* 59(PD12)* 60(PD13)* 61(PD14)* 62(PD15)* 63(PC6)* 64(PC7)* 65(PC8)* 66(PC9)* 67(PA8)* 72(PA13)* 76(PA14)* 77(PA15)* 80(PC12)* 91(PB5)* 92(PB6)* 93(PB7)* 95(PB8)*; U2 2(PE3)* 3(PE4)* 7(PC13)* 15(PC0)* 16(PC1)* 17(PC2_C)* 18(PC3_C)* 40(PE10)* 41(PE11)* 44(PE14)* 45(PE15)* 47(PB11)* 57(PD10)* 60(PD13)* 61(PD14)* 62(PD15)* 63(PC6)* 64(PC7)* 67(PA8)* 72(PA13)* 76(PA14)* 81(PD0)* 93(PB7)* 95(PB8)* 96(PB9)*; U3 2(PC13)* 14(PA2)* 30(PB10)*
